# EasyEDA Pro project Chessboards.epro, board Diagonal (continued)
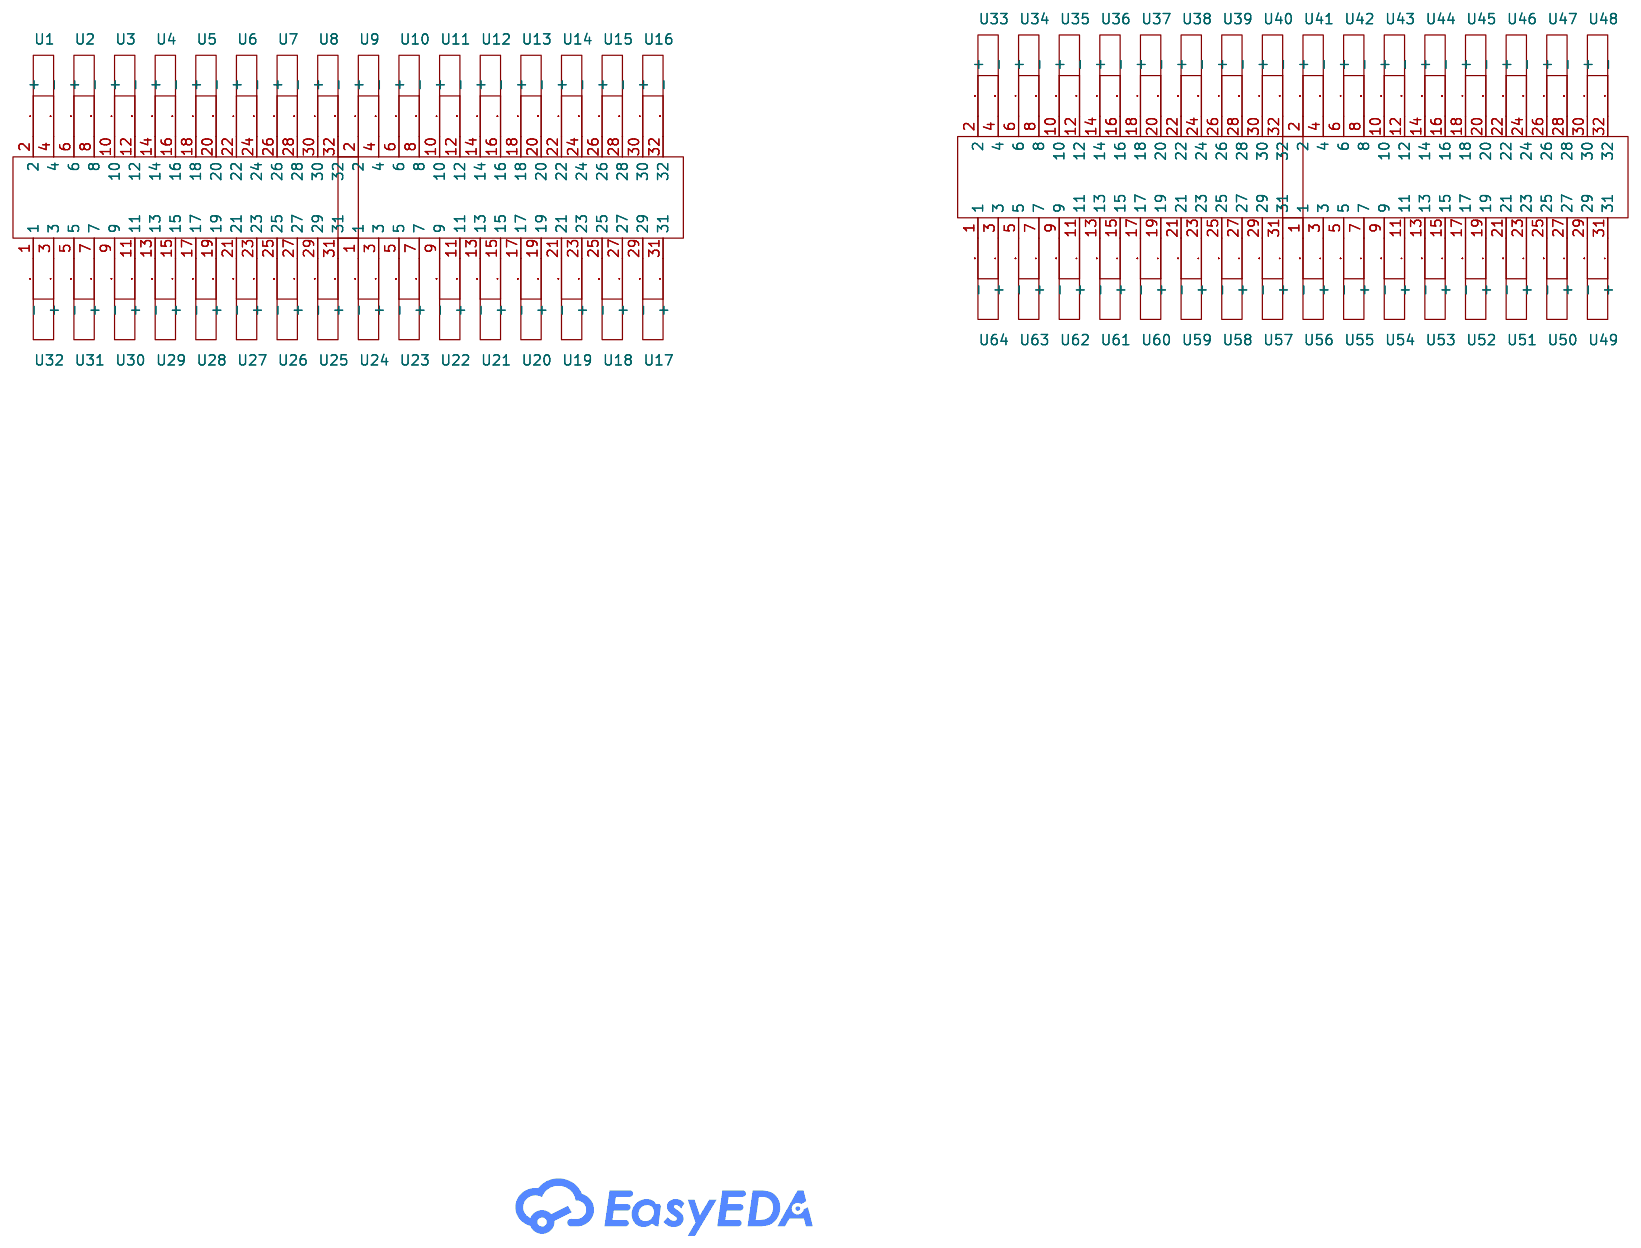
[diagram p0: schematic sheet]
## Routing (per net, layer and track width the routed paths; a pad name or vN(x,y) marks a point on that pad's centre or on a via; arc(x,y) is an arc through that point) (continued)
  Inner4 w0.254: 348.2,56.76 348.2,41.02 353.62,35.6 373.32,35.6 374.13,34.8 374.13,31.6 370,27.47 v2(370,3.71) ; 149.8,54.06 149.8,41.6 155.37,36.03 157.69,36.03 158.7,35.02 158.7,30.76 155.49,27.55 155.49,3.72 ; v2(98.75,476.35) 98.75,447.24 91.86,440.36 91.86,438.14 79.96,426.24 79.96,411.26 89.72,401.5 95.27,401.5 95.45,401.68 90.62,406.51 v1(90.62,407.02) ; 191.24,56.44 191.24,41.29 196.24,36.29 215.94,36.29 217.17,35.07 217.17,29.74 214.87,27.44 214.87,3.69 ; 171.41,53.21 171.41,53.72 169.8,55.33 169.8,60.02 165.89,63.93 160.19,63.93 150.17,53.91 ; 153.02,52.73 161.37,61.08 164.71,61.08 166.95,58.84 166.95,57.26 163.41,53.72 163.41,53.21 ; 35.68,55.58 40.26,60.15 48.37,60.15 49.38,59.14 49.38,55.97 47.13,53.72 U3.10 ; v2(75.47,476.35) 75.47,445.34 70.42,440.29 70.42,436.54 67.53,433.65 47.45,433.65 44.25,430.44 ; 348.9,56.46 354.73,62.29 364.61,62.29 366.87,60.02 366.87,55.33 368.48,53.72 368.48,53.21 ; U5.70 379.61,406.56 376.07,403.02 376.07,399.81 373.18,396.92 360.29,396.92 355.71,401.5 355.71,432.11 ; 209.81,53.19 209.81,53.69 208.85,54.66 208.85,59.85 206.79,61.9 197.2,61.9 191.59,56.29 ; 110.97,57.05 117.63,63.71 128.69,63.71 131.79,60.61 131.79,57.9 135.97,53.72 v1(135.97,53.21) ; 436.69,431.22 436.69,402.38 440.01,399.05 451.13,399.05 452.77,400.69 452.77,406.23 452.45,406.56 452.45,407.06 ; 308.21,53.76 318.02,63.58 323.42,63.58 327.12,59.87 327.12,54.68 328.09,53.72 328.09,53.21 ; v1(288.72,407.02) 288.72,406.51 292.9,402.33 292.9,401.54 292.51,401.15 283.16,401.15 281.09,403.22 281.09,430.29 ; 121.64,431.06 125.68,435.1 145.75,435.1 147.81,437.16 147.81,443.99 149.19,445.37 149.19,476.38 ; 193.37,55.55 193.37,42.18 197.12,38.43 216.83,38.43 219.3,35.95 219.3,30.66 222.52,27.44 222.52,3.69 ; 199.44,431.47 204.11,436.14 224.18,436.14 225.61,437.57 225.61,443.96 224.23,445.34 v2(224.23,476.35) ; 124.97,53.21 124.97,53.72 127.87,56.61 127.87,58.99 127.06,59.79 119.25,59.79 114.88,55.43 ; 462.85,3.71 462.85,27.47 456.89,33.44 456.89,36.42 453.79,39.52 434.08,39.52 430.96,42.64 430.96,55.13 ; 455.69,476.39 455.69,445.38 460.74,440.33 460.74,438.2 460.14,437.61 440.07,437.61 434.56,432.1 ; 32.13,57.05 32.13,40.73 37.97,34.89 57.67,34.89 58.06,34.5 58.06,33.44 52.09,27.47 v2(52.09,3.71) ; 43.52,430.74 43.52,402.78 46.22,400.08 56.46,400.08 57.47,401.09 57.47,404.26 55.22,406.51 U2.120 ; 438.11,430.63 438.11,402.97 440.6,400.48 450.54,400.48 451.35,401.28 451.35,403.66 448.45,406.56 448.45,407.06 ; v2(252.61,476.35) 252.61,447.24 248.48,443.11 248.48,438.59 236.57,426.69 236.57,410.82 246.96,400.44 253.4,400.44 254.21,401.24 254.21,403.62 251.31,406.51 v1(251.31,407.02) ; v2(234.43,476.35) 234.43,445.34 228.46,439.37 228.46,436.39 225.36,433.29 205.29,433.29 202.28,430.29 ; v2(239.87,476.35) 239.87,447.24 244.92,442.19 244.92,440.06 233.01,428.16 233.01,409.35 245.49,396.88 254.87,396.88 257.76,399.77 257.76,402.97 261.31,406.51 U1.70 ; 347.84,56.9 347.84,40.88 353.47,35.25 373.17,35.25 373.77,34.65 373.77,32.52 368.72,27.47 v2(368.72,3.71) ; v2(71.55,3.72) 71.55,27.55 78.31,34.3 78.31,34.56 78.25,34.61 75.93,34.61 69.53,41.01 69.53,54.65 ; 311.41,52.44 319.35,60.37 322.1,60.37 323.79,58.67 323.79,58.42 319.09,53.72 319.09,53.21 ; 140.27,476.38 140.27,445.37 145.32,440.32 145.32,438.19 144.72,437.59 124.65,437.59 119.15,432.09 ; 44.59,430.29 44.59,403.22 46.66,401.15 56.01,401.15 56.4,401.54 56.4,402.33 52.22,406.51 v1(52.22,407.02) ; 213.81,53.19 213.81,53.69 210.27,57.23 210.27,60.44 207.38,63.33 196.61,63.33 190.16,56.88 ; 180.44,407.04 180.44,406.54 178.19,404.29 178.19,400.09 175.71,397.61 166.91,397.61 154.86,409.67 154.86,427.89 166.76,439.79 166.76,444.05 163.55,447.27 163.55,476.37 ; 197.65,432.21 197.65,401.3 202.43,396.52 215.61,396.52 218.71,399.62 218.71,402.33 222.9,406.51 U1.100 ; U1.50 294.72,406.51 295.04,406.19 295.04,400.65 293.4,399.01 282.28,399.01 278.95,402.34 278.95,431.18 ; 352.11,55.13 356.05,59.08 363.28,59.08 363.67,58.69 363.67,57.9 359.48,53.72 v1(359.48,53.21) ; 462.06,476.39 462.06,445.38 462.52,444.92 462.52,437.47 460.88,435.83 440.8,435.83 436.34,431.37 ; 123.05,430.47 123.05,403.1 125.33,400.82 134.98,400.82 135.57,401.41 135.57,403 132.03,406.54 v1(132.03,407.02) 132.03,407.04 ; 320.09,53.21 320.09,53.72 324.28,57.9 324.28,58.69 322.24,60.73 319.2,60.73 311.06,52.58 ; 356.78,431.67 356.78,401.94 360.73,397.99 372.74,397.99 375,400.25 375,404.95 376.61,406.56 U5.76 ; 371.48,53.21 371.48,53.72 367.94,57.26 367.94,60.46 365.05,63.35 354.28,63.35 347.83,56.9 ; 309.62,53.17 309.62,42.49 313.94,38.17 316.26,38.17 318.52,35.91 318.52,29.84 320.82,27.55 320.82,3.72 ; 309.42,476.35 309.42,445.34 306.21,442.13 306.21,436.83 303.73,434.36 283.66,434.36 280.03,430.74 ; 231.5,52.85 240.06,61.41 243.69,61.41 246.15,58.96 246.15,56.59 243.25,53.69 U4.40 243.25,53.19 ; 167.37,476.37 167.37,447.27 167.83,446.81 167.83,439.35 155.93,427.45 155.93,410.11 167.36,398.68 175.27,398.68 177.12,400.53 177.12,406.22 177.44,406.54 177.44,407.04 ; 95.62,407.02 95.62,406.51 97.23,404.9 97.23,400.95 96.01,399.72 88.98,399.72 78.18,410.53 78.18,426.98 90.08,438.88 90.08,444.95 92.38,447.24 v2(92.38,476.35) ; U4.78 285.66,53.72 286.62,54.68 286.62,59.43 285.19,60.86 276.49,60.86 271.5,55.87 ; 173.41,53.21 173.41,53.72 170.51,56.61 170.51,60.32 166.18,64.64 159.89,64.64 149.46,54.21 ; 437.06,431.07 441.1,435.11 461.17,435.11 463.23,437.17 463.23,444.01 464.61,445.38 464.61,476.39 ; 272.92,55.28 277.08,59.44 284.6,59.44 285.2,58.84 285.2,57.26 281.66,53.72 U4.70 ; U6.54 407.92,53.72 406.31,55.33 406.31,60.02 402.4,63.93 396.7,63.93 386.68,53.91 ; 356.07,431.96 356.07,401.64 360.44,397.28 373.03,397.28 375.71,399.96 375.71,403.66 378.61,406.56 U5.72 ; v2(221.69,476.35) 221.69,445.34 224.9,442.13 224.9,437.87 223.88,436.85 203.81,436.85 198.72,431.77 ; v2(71.65,476.35) 71.65,445.34 69.35,443.05 69.35,436.98 67.09,434.72 47.01,434.72 43.18,430.88 ; 449.45,407.06 449.45,406.56 451.71,404.3 451.71,401.13 450.69,400.12 440.46,400.12 437.76,402.82 437.76,430.78 ; 269.72,56.61 275.75,62.64 285.93,62.64 288.4,60.17 288.4,55.97 290.66,53.72 U4.88 ; 434.55,432.1 434.55,401.49 439.13,396.92 452.02,396.92 454.91,399.81 454.91,403.01 458.45,406.56 458.45,407.06 ; 34.26,56.17 39.67,61.57 48.96,61.57 50.81,59.73 50.81,54.04 51.13,53.72 U3.18 ; 113.11,56.17 113.11,41.61 117.69,37.03 137.4,37.03 139.04,35.39 139.04,27.93 138.58,27.47 138.58,3.71 ; U1.88 252.31,406.51 254.56,404.26 254.56,401.09 253.55,400.08 246.81,400.08 236.22,410.68 236.22,426.83 248.12,438.73 248.12,444.03 251.33,447.24 v2(251.33,476.35) ; 198.71,431.77 198.71,401.75 202.87,397.59 215.17,397.59 217.65,400.06 217.65,404.26 219.9,406.51 U1.106 ; U5.52 412.02,406.56 412.99,405.59 412.99,400.84 411.55,399.41 404.23,399.41 393.22,410.43 393.22,427.17 405.12,439.07 405.12,445.91 406.5,447.29 406.5,476.39 ; 95.56,53.21 95.56,53.72 92.02,57.26 92.02,60.46 87.48,65 80.9,65 70.26,54.35 ; 200.86,430.88 204.69,434.72 224.77,434.72 227.03,436.98 227.03,443.05 229.33,445.34 v2(229.33,476.35) ; 358.57,430.93 362.41,434.76 382.48,434.76 384.75,437.03 384.75,443.09 387.04,445.39 387.04,476.4 ; 438.47,430.48 438.47,403.11 440.75,400.83 450.4,400.83 450.99,401.43 450.99,403.01 447.45,406.56 447.45,407.06 ; 306.46,3.71 306.46,27.47 299.57,34.36 299.57,36.57 296.26,39.88 276.56,39.88 273.64,42.79 273.64,54.99 ; 41.75,431.47 46.42,436.14 66.5,436.14 67.93,437.57 67.93,443.96 66.55,445.34 v2(66.55,476.35) ; 358.22,431.08 362.26,435.12 382.34,435.12 384.39,437.18 384.39,444.01 385.77,445.39 385.77,476.4 ; v2(66.11,3.71) 66.11,27.47 61.98,31.6 61.98,36.13 59.29,38.81 39.59,38.81 36.05,42.35 36.05,55.43 ; 356.79,431.67 361.67,436.54 381.75,436.54 382.97,437.76 382.97,443.09 380.67,445.39 380.67,476.4 ; 71.67,53.76 71.67,41.9 76.82,36.75 79.14,36.75 80.57,35.32 80.57,28.92 79.19,27.55 v2(79.19,3.72) ; 268.29,57.2 275.16,64.07 286.52,64.07 289.83,60.76 289.83,58.55 294.66,53.72 v1(294.66,53.21) ; 133.03,407.04 v1(133.03,407.02) 133.03,406.54 135.93,403.64 135.93,401.27 135.12,400.46 125.18,400.46 122.69,402.95 122.69,430.61 ; 118.78,432.24 118.78,401.33 123.56,396.55 136.75,396.55 139.85,399.65 139.85,402.35 144.03,406.54 144.03,407.04 ; 114.53,55.58 119.1,60.15 127.21,60.15 128.23,59.14 128.23,55.97 125.97,53.72 125.97,53.21 ; 348.55,56.61 348.55,41.17 353.76,35.96 373.47,35.96 374.48,34.95 374.48,30.68 371.27,27.47 v2(371.27,3.71) ; 429.53,55.72 434.31,60.51 442.71,60.51 443.94,59.28 443.94,55.33 442.33,53.72 U6.76 ; 272.57,55.43 272.57,42.35 276.11,38.81 295.82,38.81 298.5,36.13 298.5,31.6 302.63,27.47 302.63,3.71 ; 205.81,53.19 205.81,53.69 207.42,55.3 207.42,59.26 206.2,60.48 197.79,60.48 193.01,55.7 ; 110.97,57.05 110.97,40.73 116.81,34.89 136.52,34.89 136.9,34.5 136.9,33.44 130.94,27.47 130.94,3.71 ; 456.45,407.06 456.45,406.56 454.2,404.3 454.2,400.1 451.72,397.63 439.42,397.63 435.27,401.79 435.27,431.81 ; U2.116 57.22,406.51 58.18,405.55 58.18,400.8 56.75,399.37 45.93,399.37 42.81,402.48 42.81,431.03 ; 141.13,3.71 141.13,27.47 139.75,28.85 139.75,35.68 137.69,37.74 117.99,37.74 113.82,41.91 113.82,55.87 ; 35.69,55.58 35.69,42.2 39.44,38.45 59.15,38.45 61.62,35.98 61.62,30.68 64.83,27.47 v2(64.83,3.71) ; 155.56,476.38 155.56,445.37 149.59,439.4 149.59,436.42 146.49,433.32 126.42,433.32 123.42,430.32 ; 36.76,55.13 36.76,42.64 39.88,39.52 59.59,39.52 62.69,36.42 62.69,33.44 68.65,27.47 v2(68.65,3.71) ; 42.47,431.18 46.72,435.43 66.79,435.43 68.64,437.28 68.64,444.88 69.1,445.34 v2(69.1,476.35) ; U3.22 53.13,53.72 51.52,55.33 51.52,60.02 49.25,62.29 39.37,62.29 33.55,56.46 ; 153.01,476.38 153.01,445.37 148.88,441.24 148.88,436.71 146.2,434.03 126.12,434.03 122.71,430.61 ; 167.41,53.21 167.41,53.72 168.37,54.68 168.37,59.43 165.3,62.51 160.78,62.51 151.59,53.32 ; v1(53.22,407.02) 53.22,406.51 56.76,402.97 56.76,401.39 56.16,400.79 46.51,400.79 44.23,403.07 44.23,430.44 ; 120.93,431.35 125.39,435.81 145.46,435.81 147.1,437.45 147.1,444.91 146.64,445.37 146.64,476.38 ; 121.99,430.91 125.83,434.74 145.9,434.74 148.17,437.01 148.17,443.07 150.46,445.37 150.46,476.38 ; 308.15,476.35 308.15,445.34 305.85,443.05 305.85,436.98 303.59,434.72 283.51,434.72 279.68,430.88 ; 452.66,3.71 452.66,27.47 454.04,28.85 454.04,35.24 452.61,36.67 432.9,36.67 428.11,41.46 428.11,56.31 ; 426.68,56.9 433.13,63.35 443.89,63.35 446.78,60.46 446.78,57.26 450.33,53.72 v1(450.33,53.21) ; v2(390.73,3.72) 390.73,27.55 394.86,31.68 394.86,34.87 394.05,35.68 391.73,35.68 385.96,41.45 385.96,54.21 ; 459.45,407.06 459.45,406.56 455.26,402.37 455.26,399.66 452.17,396.56 438.98,396.56 434.2,401.34 434.2,432.25 ; 158.04,3.72 158.04,27.55 159.41,28.92 159.41,35.32 157.98,36.75 155.66,36.75 150.51,41.9 150.51,53.76 ; U6.74 441.33,53.72 443.58,55.97 443.58,59.14 442.57,60.15 434.45,60.15 429.88,55.58 ; 41.4,431.62 46.27,436.5 66.35,436.5 67.57,437.72 67.57,443.05 65.28,445.34 v2(65.28,476.35) ; 464.13,3.71 464.13,27.47 457.24,34.36 457.24,36.57 453.93,39.88 434.23,39.88 431.31,42.79 431.31,54.99 ; 278.6,431.32 278.6,402.19 282.13,398.66 293.55,398.66 295.39,400.5 295.39,406.19 295.72,406.51 U1.48 ; 271.86,55.72 271.86,42.06 275.82,38.1 295.53,38.1 297.79,35.83 297.79,29.77 300.09,27.47 300.09,3.71 ; U1.40 299.72,406.51 296.82,403.62 296.82,399.91 294.13,397.23 281.54,397.23 277.17,401.6 277.17,431.91 ; 306.06,54.65 306.06,41.01 312.46,34.61 314.78,34.61 314.83,34.56 314.83,34.3 308.08,27.55 308.08,3.72 ; v2(86.01,476.35) 86.01,447.24 88.3,444.95 88.3,439.62 76.4,427.72 76.4,409.79 88.25,397.94 96.75,397.94 99.01,400.21 99.01,404.9 100.62,406.51 100.62,407.02 ; 230.79,53.15 239.77,62.13 243.99,62.13 246.86,59.26 246.86,55.3 245.25,53.69 U4.44 245.25,53.19 ; 389.17,52.88 397.73,61.44 401.36,61.44 403.82,58.99 403.82,56.61 400.92,53.72 U6.40 ; 72.04,53.62 81.64,63.22 86.75,63.22 90.24,59.73 90.24,54.04 90.56,53.72 90.56,53.21 ; 151.67,3.72 151.67,27.55 157.63,33.51 157.63,34.58 157.25,34.97 154.93,34.97 148.73,41.16 148.73,54.5 ; 305.18,3.71 305.18,27.47 299.21,33.44 299.21,36.42 296.12,39.52 276.41,39.52 273.28,42.64 273.28,55.13 ; 91.56,53.21 91.56,53.72 90.6,54.68 90.6,59.87 86.9,63.58 81.49,63.58 71.68,53.76 ; 323.36,3.72 323.36,27.55 319.23,31.68 319.23,36.2 316.55,38.88 314.23,38.88 310.33,42.78 310.33,52.88 ; 281.45,430.14 281.45,403.37 283.31,401.5 292.37,401.5 292.55,401.68 287.72,406.51 v1(287.72,407.02) ; 143.68,3.71 143.68,27.47 140.46,30.68 140.46,35.98 137.99,38.45 118.28,38.45 114.53,42.2 114.53,55.58 ; v2(74.19,476.35) 74.19,445.34 70.06,441.21 70.06,436.69 67.38,434 47.31,434 43.89,430.59 ; 151.24,53.47 160.63,62.86 165.44,62.86 168.73,59.58 168.73,54.04 168.41,53.72 168.41,53.21 ; 429.18,55.87 429.18,41.91 433.34,37.74 453.05,37.74 455.11,35.68 455.11,28.85 456.48,27.47 456.48,3.71 ; 190.17,56.88 190.17,40.85 195.8,35.22 215.5,35.22 216.1,34.62 216.1,32.49 211.05,27.44 211.05,3.69 ; v2(220.41,476.35) 220.41,445.34 224.54,441.21 224.54,438.01 223.74,437.21 203.66,437.21 198.37,431.91 ; 192.3,55.99 197.5,61.19 206.49,61.19 208.13,59.55 208.13,54.01 207.81,53.69 207.81,53.19 ; v1(452.33,53.21) 452.33,53.72 447.5,58.55 447.5,60.76 444.19,64.07 432.83,64.07 425.97,57.2 ; 367.48,53.21 367.48,53.72 366.52,54.68 366.52,59.87 364.46,61.93 354.87,61.93 349.26,56.31 ; 355.01,432.4 360.93,438.32 381.01,438.32 381.19,438.5 374.3,445.39 374.3,476.4 ; U6.86 447.33,53.72 445.72,55.33 445.72,60.02 443.45,62.29 433.57,62.29 427.75,56.46 ; 336.12,407.02 336.12,406.51 335.16,405.55 335.16,400.36 333.1,398.3 324.89,398.3 313.25,409.94 313.25,427.57 325.16,439.47 325.16,445.86 323.78,447.24 323.78,476.35 ; U4.66 279.66,53.72 284.49,58.55 284.31,58.73 277.37,58.73 273.63,54.99 ; 296.68,476.35 296.68,445.34 302.65,439.37 302.65,438.31 302.26,437.92 282.18,437.92 276.47,432.21 ; 74.87,52.44 74.87,43.22 78.15,39.95 80.47,39.95 83.77,36.64 83.77,34.43 90.66,27.55 v2(90.66,3.72) ; 166.95,3.72 166.95,27.55 161.91,32.59 161.91,36.35 159.01,39.24 156.69,39.24 153,42.93 153,52.73 ; 437.41,430.92 441.25,434.76 461.32,434.76 463.59,437.02 463.59,443.09 465.88,445.38 465.88,476.39 ; 389.59,476.4 389.59,445.39 385.46,441.26 385.46,436.73 382.78,434.05 362.7,434.05 359.29,430.63 ; v2(75.37,3.72) 75.37,27.55 79.5,31.68 79.5,34.87 78.7,35.68 76.38,35.68 70.6,41.45 70.6,54.21 ; 113.46,56.02 113.46,41.76 117.84,37.38 137.55,37.38 139.4,35.54 139.4,27.93 139.85,27.47 139.85,3.71 ; U1.118 213.9,406.51 215.51,404.9 215.51,400.95 214.29,399.72 203.76,399.72 200.85,402.63 200.85,430.88 ; v2(402.19,3.72) 402.19,27.55 398.06,31.68 398.06,36.2 395.38,38.88 393.06,38.88 389.16,42.78 389.16,52.88 ; U5.64 406.02,406.56 410.85,401.73 410.67,401.55 405.12,401.55 395.36,411.31 395.36,426.29 407.26,438.19 407.26,440.4 414.14,447.29 414.14,476.39 ; 437.05,431.07 437.05,402.52 440.16,399.41 450.99,399.41 452.42,400.84 452.42,405.59 451.45,406.56 451.45,407.06 ; 357.51,431.37 361.97,435.83 382.04,435.83 383.68,437.47 383.68,444.93 383.22,445.39 383.22,476.4 ; 271.5,55.87 271.5,41.91 275.67,37.74 295.38,37.74 297.43,35.68 297.43,28.85 298.81,27.47 298.81,3.71 ; 453.14,476.39 453.14,445.38 460.03,438.5 459.85,438.32 439.77,438.32 433.85,432.4 ; 387.74,53.47 387.74,42.19 392.47,37.46 394.79,37.46 396.64,35.61 396.64,28 397.1,27.55 v2(397.1,3.72) ; 145.37,476.38 145.37,445.37 146.74,443.99 146.74,437.6 145.31,436.17 125.24,436.17 120.57,431.5 ; 269.36,56.76 275.6,63 286.08,63 288.76,60.32 288.76,56.61 291.66,53.72 v1(291.66,53.21) ; 296.26,3.71 296.26,27.47 296.72,27.93 296.72,35.39 295.08,37.03 275.38,37.03 270.79,41.61 270.79,56.17 ; v1(210.9,407.02) 210.9,406.51 214.44,402.97 214.44,401.39 213.84,400.79 204.2,400.79 201.92,403.07 201.92,430.44 ; 119.86,431.79 124.94,436.88 145.02,436.88 146.03,437.89 146.03,442.15 142.82,445.37 142.82,476.38 ; 231.13,53 231.13,42.61 235.24,38.5 237.56,38.5 240.03,36.03 240.03,30.73 243.25,27.52 243.25,3.69 ; 119.13,432.09 119.13,401.48 123.71,396.9 136.6,396.9 139.49,399.79 139.49,403 143.03,406.54 143.03,407.04 ; 270.07,56.46 275.9,62.29 285.78,62.29 288.05,60.02 288.05,55.33 289.66,53.72 U4.86 ; 176.44,407.04 176.44,406.54 176.76,406.22 176.76,400.68 175.12,399.04 167.5,399.04 156.28,410.26 156.28,427.3 168.19,439.2 168.19,446.81 168.64,447.27 168.64,476.37 ; 301.36,3.71 301.36,27.47 298.15,30.68 298.15,35.98 295.67,38.45 275.97,38.45 272.22,42.2 272.22,55.58 ; U2.106 62.22,406.51 59.96,404.26 59.96,400.06 57.49,397.59 45.19,397.59 41.03,401.75 41.03,431.77 ; 270.44,56.31 270.44,41.46 275.23,36.67 294.94,36.67 296.37,35.24 296.37,28.85 294.99,27.47 294.99,3.71 ; 244.25,53.19 U4.42 244.25,53.69 246.5,55.94 246.5,59.11 243.84,61.77 239.91,61.77 231.14,53 ; 388.46,53.17 397.44,62.15 401.66,62.15 404.53,59.28 404.53,55.33 402.92,53.72 U6.44 ; 230.78,53.15 230.78,42.46 235.09,38.14 237.41,38.14 239.68,35.88 239.68,29.81 241.97,27.52 241.97,3.69 ; 385.6,54.35 385.6,41.31 391.58,35.32 393.9,35.32 394.5,34.73 394.5,32.59 389.45,27.55 v2(389.45,3.72) ; 74.52,52.58 74.52,43.08 78,39.59 80.32,39.59 83.42,36.5 83.42,33.51 89.38,27.55 v2(89.38,3.72) ; 148.77,3.71 148.77,27.47 141.89,34.36 141.89,36.57 138.58,39.88 118.87,39.88 115.96,42.79 115.96,54.99 ; 411.59,476.39 411.59,447.29 406.54,442.24 406.54,438.49 394.64,426.58 394.64,411.02 404.82,400.84 410.97,400.84 411.56,401.43 411.56,403.02 408.02,406.56 U5.60 ; 292.44,3.71 292.44,27.47 295.65,30.68 295.65,34.95 294.64,35.96 274.94,35.96 269.72,41.17 269.72,56.61 ; 357.85,431.22 357.85,402.38 361.17,399.06 372.29,399.06 373.93,400.7 373.93,406.24 373.61,406.56 U5.82 ; 455.45,407.06 455.45,406.56 453.84,404.94 453.84,400.25 451.58,397.99 439.57,397.99 435.62,401.93 435.62,431.66 ; 162.41,53.21 162.41,53.72 166.59,57.9 166.59,58.69 164.56,60.73 161.52,60.73 153.37,52.58 ; 181.44,407.04 181.44,406.54 178.54,403.64 178.54,399.94 175.86,397.26 166.77,397.26 154.5,409.52 154.5,428.04 166.41,439.94 166.41,443.14 162.27,447.27 162.27,476.37 ; U6.82 445.33,53.72 445,54.04 445,59.73 443.16,61.57 433.87,61.57 428.46,56.17 ; 163.13,3.72 163.13,27.55 160.84,29.84 160.84,35.91 158.57,38.17 156.25,38.17 151.94,42.49 151.94,53.17 ; 140.03,407.04 140.03,406.54 138.42,404.93 138.42,400.24 136.16,397.97 124.15,397.97 120.2,401.92 120.2,431.65 ; v2(64,476.35) 64,445.34 67.22,442.13 67.22,437.87 66.2,436.85 46.13,436.85 41.04,431.77 ; v1(358.48,53.21) 358.48,53.72 363.31,58.55 363.13,58.73 356.2,58.73 352.46,54.99 ; 232.56,52.41 232.56,43.2 235.83,39.92 238.15,39.92 241.46,36.62 241.46,34.4 248.34,27.52 248.34,3.69 ; 209.78,3.69 209.78,27.44 215.74,33.41 215.74,34.48 215.35,34.87 195.65,34.87 189.81,40.7 189.81,57.03 ; 227.58,54.48 238.44,65.33 245.32,65.33 250.06,60.58 250.06,57.88 254.25,53.69 v1(254.25,53.21) 254.25,53.19 ; v2(253.88,476.35) 253.88,447.24 248.83,442.19 248.83,438.44 236.93,426.54 236.93,410.97 247.11,400.79 253.25,400.79 253.85,401.39 253.85,402.97 250.31,406.51 v1(250.31,407.02) ; v2(77.92,3.72) 77.92,27.55 80.21,29.84 80.21,35.17 78.99,36.39 76.67,36.39 71.31,41.75 71.31,53.91 ; 229.35,53.74 229.35,41.87 234.5,36.72 236.82,36.72 238.25,35.29 238.25,28.9 236.88,27.52 236.88,3.69 ; 358.56,430.93 358.56,402.68 361.47,399.77 372,399.77 373.22,400.99 373.22,404.95 371.61,406.56 U5.86 ; v2(59.74,3.71) 59.74,27.47 60.2,27.93 60.2,35.39 58.56,37.03 38.85,37.03 34.27,41.61 34.27,56.17 ; v2(69.93,3.71) 69.93,27.47 63.04,34.36 63.04,36.57 59.74,39.88 40.03,39.88 37.11,42.79 37.11,54.99 ; 39.97,432.21 45.68,437.92 65.76,437.92 66.15,438.31 66.15,439.37 60.18,445.34 v2(60.18,476.35) ; 279.31,431.03 279.31,402.48 282.42,399.37 293.25,399.37 294.68,400.8 294.68,405.55 293.72,406.51 U1.52 ; 362.48,53.21 362.48,53.72 364.74,55.97 364.74,59.14 363.72,60.15 355.61,60.15 351.04,55.58 ; 197.3,432.36 203.22,438.28 223.29,438.28 223.47,438.46 216.59,445.34 v2(216.59,476.35) ; 227.94,54.33 238.59,64.97 245.17,64.97 249.71,60.44 249.71,57.23 253.25,53.69 v1(253.25,53.21) 253.25,53.19 ; 324.09,53.21 324.09,53.72 325.7,55.33 325.7,59.28 322.83,62.15 318.61,62.15 309.63,53.17 ; v2(80.91,476.35) 80.91,447.24 86.88,441.27 86.88,440.21 74.98,428.31 74.98,409.2 87.66,396.52 97.34,396.52 100.44,399.62 100.44,402.33 104.62,406.51 104.62,407.02 ; 171.44,407.04 171.44,406.54 174.98,403 174.98,401.41 174.39,400.82 168.24,400.82 158.06,411 158.06,426.56 169.97,438.47 169.97,442.22 175.01,447.27 175.01,476.37 ; 322.09,53.21 322.09,53.72 324.99,56.61 324.99,58.99 322.54,61.44 318.9,61.44 310.34,52.88 ; v2(84.73,476.35) 84.73,447.24 87.95,444.03 87.95,439.77 76.04,427.87 76.04,409.64 88.1,397.59 96.9,397.59 99.37,400.06 99.37,404.26 101.62,406.51 101.62,407.02 ; 460.45,407.06 460.45,406.56 455.62,401.73 455.62,399.51 452.31,396.21 438.83,396.21 433.84,401.2 433.84,432.4 ; 141.54,476.38 141.54,445.37 145.68,441.24 145.68,438.04 144.87,437.24 124.8,437.24 119.5,431.94 ; 304.32,476.35 304.32,445.34 304.78,444.88 304.78,437.42 303.14,435.78 283.07,435.78 278.61,431.32 ; 35.33,55.72 40.11,60.51 48.52,60.51 49.74,59.28 49.74,55.33 48.13,53.72 U3.12 ; 437.77,430.78 441.39,434.4 461.47,434.4 463.94,436.88 463.94,442.17 467.15,445.38 467.15,476.39 ; 355.73,432.11 361.23,437.61 381.3,437.61 381.9,438.21 381.9,440.34 376.85,445.39 376.85,476.4 ; 115.6,55.13 115.6,42.64 118.73,39.52 138.43,39.52 141.53,36.42 141.53,33.44 147.5,27.47 147.5,3.71 ; 191.59,56.29 191.59,41.44 196.39,36.65 216.09,36.65 217.52,35.21 217.52,28.82 216.15,27.44 216.15,3.69 ; 355.36,432.26 355.36,401.35 360.14,396.57 373.33,396.57 376.43,399.66 376.43,402.37 380.61,406.56 U5.68 ; 359.99,430.34 359.99,403.27 362.06,401.19 371.41,401.19 371.8,401.58 371.8,402.37 367.61,406.56 U5.94 ; 111.32,56.9 117.77,63.35 128.54,63.35 131.43,60.46 131.43,57.26 134.97,53.72 v1(134.97,53.21) ; 388.32,476.4 388.32,445.39 385.1,442.17 385.1,436.88 382.63,434.41 362.56,434.41 358.93,430.78 ; 191.95,56.14 191.95,41.59 196.53,37 216.24,37 217.88,35.36 217.88,27.9 217.42,27.44 217.42,3.69 ; 131.03,407.04 v1(131.03,407.02) 131.03,406.54 135.22,402.35 135.22,401.56 134.83,401.17 125.48,401.17 123.41,403.25 123.41,430.32 ; 297.54,3.71 297.54,27.47 297.08,27.93 297.08,35.54 295.23,37.38 275.52,37.38 271.15,41.76 271.15,56.02 ; U1.38 300.72,406.51 297.17,402.97 297.17,399.77 294.28,396.88 281.39,396.88 276.82,401.45 276.82,432.06 ; 427.39,56.61 433.42,62.64 443.6,62.64 446.07,60.17 446.07,55.97 448.33,53.72 U6.88 ; 99.62,407.02 99.62,406.51 98.66,405.55 98.66,400.36 96.6,398.3 88.39,398.3 76.76,409.94 76.76,427.57 88.66,439.47 88.66,445.86 87.28,447.24 v2(87.28,476.35) ; 358.92,430.78 358.92,402.82 361.62,400.13 371.85,400.13 372.87,401.14 372.87,404.31 370.61,406.56 U5.88 ; 268.65,57.05 275.31,63.71 286.37,63.71 289.47,60.61 289.47,57.9 293.66,53.72 v1(293.66,53.21) ; 347.48,57.05 354.14,63.71 365.2,63.71 368.3,60.61 368.3,57.9 372.48,53.72 372.48,53.21 ; 94.62,407.02 94.62,406.51 96.88,404.26 96.88,401.09 95.86,400.08 89.13,400.08 78.54,410.68 78.54,426.83 90.44,438.73 90.44,444.03 93.65,447.24 v2(93.65,476.35) ; v1(208.9,407.02) 208.9,406.51 213.73,401.68 213.55,401.5 204.49,401.5 202.63,403.37 202.63,430.14 ; U1.80 256.31,406.51 255.99,406.19 255.99,400.5 254.14,398.66 246.22,398.66 234.79,410.08 234.79,427.42 246.7,439.32 246.7,446.78 246.24,447.24 v2(246.24,476.35) ; U5.44 416.02,406.56 414.41,404.95 414.41,400.25 412.14,397.99 403.64,397.99 391.8,409.84 391.8,427.76 403.7,439.66 403.7,444.99 401.4,447.29 401.4,476.39 ; v2(83.46,476.35) 83.46,447.24 87.59,443.11 87.59,439.91 75.69,428.01 75.69,409.5 87.95,397.23 97.04,397.23 99.73,399.91 99.73,403.62 102.62,406.51 102.62,407.02 ; 434.91,431.96 434.91,401.64 439.28,397.27 451.87,397.27 454.55,399.96 454.55,403.66 457.45,406.56 457.45,407.06 ; 42.11,431.32 46.57,435.78 66.64,435.78 68.28,437.42 68.28,444.88 67.82,445.34 v2(67.82,476.35) ; 42.45,431.18 42.45,402.34 45.78,399.01 56.9,399.01 58.54,400.65 58.54,406.19 58.22,406.51 U2.114 ; 445.02,3.71 445.02,27.47 451.77,34.23 451.77,34.48 451.72,34.54 432.02,34.54 425.97,40.58 425.97,57.2 ; 228.65,54.03 238.88,64.26 244.87,64.26 248.99,60.14 248.99,55.94 251.25,53.69 U4.56 251.25,53.19 ; 429.89,55.58 429.89,42.2 433.64,38.45 453.34,38.45 455.82,35.98 455.82,30.68 459.03,27.47 459.03,3.71 ; v2(67.38,3.71) 67.38,27.47 62.33,32.52 62.33,36.27 59.44,39.16 39.74,39.16 36.4,42.5 36.4,55.28 ; 460.78,476.39 460.78,445.38 462.16,444.01 462.16,437.61 460.73,436.18 440.66,436.18 435.99,431.51 ; 434.92,431.96 440.22,437.25 460.29,437.25 461.09,438.06 461.09,441.25 456.96,445.38 456.96,476.39 ; v2(80.47,3.72) 80.47,27.55 80.93,28 80.93,35.46 79.29,37.1 76.97,37.1 72.03,42.04 72.03,53.62 ; 269.01,56.9 275.46,63.35 286.22,63.35 289.11,60.46 289.11,57.26 292.66,53.72 v1(292.66,53.21) ; 210.81,53.19 210.81,53.69 209.2,55.3 209.2,60 206.94,62.26 197.06,62.26 191.23,56.44 ; 129.97,53.21 129.97,53.72 129.65,54.04 129.65,59.73 127.8,61.57 118.51,61.57 113.1,56.17 ; 299.23,476.35 299.23,445.34 303.36,441.21 303.36,438.01 302.55,437.21 282.48,437.21 277.19,431.91 ; 436.7,431.22 440.95,435.47 461.03,435.47 462.87,437.32 462.87,444.92 463.33,445.38 463.33,476.39 ; 44.96,430.14 47.75,432.94 67.82,432.94 71.13,436.24 71.13,438.46 78.02,445.34 v2(78.02,476.35) ; v1(133.97,53.21) 133.97,53.72 131.07,56.61 131.07,60.32 128.39,63 117.92,63 111.68,56.76 ; 276.11,432.36 276.11,401.16 281.1,396.16 294.58,396.16 297.88,399.47 297.88,401.68 302.72,406.51 U1.34 ; 40.69,431.91 45.98,437.21 66.05,437.21 66.86,438.01 66.86,441.21 62.73,445.34 v2(62.73,476.35) ; v2(255.16,476.35) 255.16,447.24 249.19,441.27 249.19,438.29 237.29,426.39 237.29,411.12 247.26,401.15 253.11,401.15 253.49,401.54 253.49,402.33 249.31,406.51 v1(249.31,407.02) ; v1(328.12,407.02) 328.12,406.51 332.31,402.33 332.31,401.54 331.92,401.15 326.07,401.15 316.1,411.12 316.1,426.39 328,438.29 328,441.27 333.97,447.24 333.97,476.35 ; 33.2,56.61 33.2,41.17 38.41,35.96 58.11,35.96 59.13,34.95 59.13,30.68 55.91,27.47 v2(55.91,3.71) ; 437.4,430.92 437.4,402.67 440.31,399.77 450.84,399.77 452.06,400.99 452.06,404.94 450.45,406.56 450.45,407.06 ; 201.93,430.44 205.14,433.65 225.21,433.65 228.1,436.54 228.1,440.29 233.15,445.34 v2(233.15,476.35) ; 269.01,56.9 269.01,40.88 274.64,35.25 294.35,35.25 294.94,34.65 294.94,32.52 289.89,27.47 289.89,3.71 ; U1.120 212.9,406.51 215.15,404.26 215.15,401.09 214.14,400.08 203.9,400.08 201.21,402.78 201.21,430.74 ; 203.81,53.19 v1(203.81,53.21) 203.81,53.69 206.71,56.59 206.71,58.96 205.9,59.77 198.09,59.77 193.72,55.4 ; 112.04,56.61 112.04,41.17 117.25,35.96 136.96,35.96 137.97,34.95 137.97,30.68 134.76,27.47 134.76,3.71 ; 229.36,53.74 239.18,63.55 244.58,63.55 248.28,59.85 248.28,54.66 249.25,53.69 U4.52 249.25,53.19 ; U3.16 50.13,53.72 50.45,54.04 50.45,59.58 48.81,61.22 39.81,61.22 34.62,56.02 ; 152.29,53.03 152.29,42.63 156.4,38.53 158.72,38.53 161.19,36.05 161.19,30.76 164.41,27.55 164.41,3.72 ; 137.31,3.71 137.31,27.47 138.68,28.85 138.68,35.24 137.25,36.67 117.55,36.67 112.75,41.46 112.75,56.31 ; 33.19,56.61 39.22,62.64 49.4,62.64 51.87,60.17 51.87,55.97 54.13,53.72 U3.24 ; 229.01,53.89 239.03,63.91 244.73,63.91 248.64,60 248.64,55.3 250.25,53.69 U4.54 250.25,53.19 ; 190.88,56.58 190.88,41.14 196.09,35.93 215.8,35.93 216.81,34.92 216.81,30.66 213.6,27.44 213.6,3.69 ; 208.5,3.69 208.5,27.44 215.26,34.2 215.26,34.46 215.21,34.51 195.5,34.51 189.46,40.55 189.46,57.17 ; 388.09,53.32 388.09,42.34 392.62,37.81 394.94,37.81 396.99,35.76 396.99,28.92 398.37,27.55 v2(398.37,3.72) ; 40.67,431.91 40.67,401.6 45.04,397.23 57.64,397.23 60.32,399.91 60.32,403.62 63.22,406.51 U2.104 ; U5.96 366.61,406.56 371.44,401.73 371.26,401.55 362.21,401.55 360.34,403.41 360.34,430.19 ; 190.52,56.73 190.52,41 195.94,35.58 215.65,35.58 216.46,34.77 216.46,31.58 212.32,27.44 212.32,3.69 ; 384.49,476.4 384.49,445.39 384.04,444.93 384.04,437.32 382.19,435.47 362.11,435.47 357.86,431.22 ; 385.24,54.5 385.24,41.16 391.44,34.97 393.76,34.97 394.14,34.58 394.14,33.51 388.18,27.55 v2(388.18,3.72) ; U1.86 253.31,406.51 254.92,404.9 254.92,400.95 253.69,399.72 246.67,399.72 235.86,410.53 235.86,426.98 247.76,438.88 247.76,444.95 250.06,447.24 v2(250.06,476.35) ; 122.34,430.76 122.34,402.8 125.04,400.11 135.27,400.11 136.29,401.12 136.29,404.29 134.03,406.54 134.03,407.04 ; v2(226.78,476.35) 226.78,445.34 226.32,444.88 226.32,437.28 224.47,435.43 204.4,435.43 200.15,431.18 ; 153.36,52.58 153.36,43.08 156.84,39.59 159.16,39.59 162.26,36.5 162.26,33.51 168.23,27.55 168.23,3.72 ; 311.9,3.72 311.9,27.55 316.03,31.68 316.03,34.87 315.22,35.68 312.9,35.68 307.13,41.45 307.13,54.21 ; U1.44 297.72,406.51 296.11,404.9 296.11,400.21 293.84,397.94 281.83,397.94 277.89,401.89 277.89,431.62 ; 36.4,55.28 40.55,59.44 48.07,59.44 48.67,58.84 48.67,57.26 45.13,53.72 v1(45.13,53.21) ; 313.24,476.35 313.24,445.34 307.27,439.37 307.27,436.39 304.18,433.29 284.1,433.29 281.1,430.29 ; 410.32,476.39 410.32,447.29 406.19,443.16 406.19,438.63 394.29,426.73 394.29,410.87 404.67,400.48 411.11,400.48 411.92,401.29 411.92,403.66 409.02,406.56 U5.58 ; 115.59,55.13 119.54,59.08 126.77,59.08 127.16,58.69 127.16,57.9 122.97,53.72 122.97,53.21 ; 347.13,57.2 347.13,40.58 353.17,34.54 372.88,34.54 372.93,34.48 372.93,34.23 366.17,27.47 v2(366.17,3.71) ; 193.73,55.4 193.73,42.32 197.27,38.78 216.98,38.78 219.66,36.1 219.66,31.58 223.79,27.44 223.79,3.69 ; 215.81,53.19 215.81,53.69 210.98,58.52 210.98,60.73 207.67,64.04 196.32,64.04 189.45,57.17 ; 232.2,52.56 232.2,43.05 235.68,39.57 238,39.57 241.1,36.47 241.1,33.49 247.07,27.52 247.07,3.69 ; 165.68,3.72 165.68,27.55 161.55,31.68 161.55,36.2 158.87,38.88 156.55,38.88 152.65,42.78 152.65,52.88 ; 183.44,407.04 183.44,406.54 179.25,402.35 179.25,399.65 176.16,396.55 166.47,396.55 153.79,409.23 153.79,428.33 165.69,440.24 165.69,441.3 159.73,447.27 159.73,476.37 ; 308.2,53.76 308.2,41.9 313.35,36.75 315.67,36.75 317.1,35.32 317.1,28.92 315.72,27.55 315.72,3.72 ; 310.69,52.73 310.69,42.93 314.38,39.24 316.7,39.24 319.59,36.35 319.59,32.59 324.64,27.55 324.64,3.72 ; 170.44,407.04 170.44,406.54 174.63,402.35 174.63,401.56 174.24,401.17 168.39,401.17 158.42,411.14 158.42,426.42 170.32,438.32 170.32,441.3 176.29,447.27 176.29,476.37 ; U5.80 374.61,406.56 374.29,406.24 374.29,400.55 372.44,398.7 361.03,398.7 357.49,402.23 357.49,431.37 ; 226.34,3.69 226.34,27.44 220.37,33.41 220.37,36.39 217.27,39.49 197.57,39.49 194.44,42.62 194.44,55.11 ; v2(242.42,476.35) 242.42,447.24 245.63,444.03 245.63,439.77 233.73,427.87 233.73,409.64 245.78,397.59 254.58,397.59 257.05,400.06 257.05,404.26 259.31,406.51 U1.74 ; 225.06,3.69 225.06,27.44 220.01,32.49 220.01,36.25 217.12,39.14 197.42,39.14 194.08,42.47 194.08,55.26 ; 239.42,3.69 239.42,27.52 238.96,27.98 238.96,35.58 237.12,37.43 234.8,37.43 230.06,42.17 230.06,53.44 ; v1(289.72,407.02) 289.72,406.51 293.26,402.97 293.26,401.39 292.66,400.79 283.01,400.79 280.73,403.07 280.73,430.44 ; 229.72,53.59 239.32,63.19 244.43,63.19 247.93,59.7 247.93,54.01 248.25,53.69 U4.50 248.25,53.19 ; 307.48,54.06 307.48,41.6 313.05,36.03 315.37,36.03 316.38,35.02 316.38,30.76 313.17,27.55 313.17,3.72 ; v2(394.55,3.72) 394.55,27.55 395.92,28.92 395.92,35.32 394.49,36.75 392.17,36.75 387.02,41.9 387.02,53.76 ; 311.4,52.44 311.4,43.22 314.67,39.95 316.99,39.95 320.3,36.64 320.3,34.43 327.19,27.55 327.19,3.72 ; 229.23,3.69 229.23,27.52 235.99,34.28 235.99,34.53 235.94,34.58 233.62,34.58 227.22,40.99 227.22,54.62 ; 395.03,476.39 395.03,447.29 401.79,440.53 401.79,440.28 390.02,428.5 390.02,409.1 402.9,396.21 412.88,396.21 416.19,399.52 416.19,401.73 421.02,406.56 U5.34 ; U1.66 263.31,406.51 258.48,401.68 258.48,399.47 255.17,396.16 245.19,396.16 232.3,409.05 232.3,428.45 244.08,440.23 244.08,440.48 237.32,447.24 v2(237.32,476.35) ; 351.75,55.28 355.91,59.44 363.43,59.44 364.02,58.84 364.02,57.26 360.48,53.72 v1(360.48,53.21) ; 43.17,430.88 43.17,402.63 46.07,399.72 56.6,399.72 57.83,400.95 57.83,404.9 56.22,406.51 U2.118 ; 199.08,431.62 203.96,436.5 224.03,436.5 225.25,437.72 225.25,443.05 222.96,445.34 v2(222.96,476.35) ; 273.28,55.13 277.23,59.08 284.45,59.08 284.84,58.69 284.84,57.9 280.66,53.72 U4.68 ; 311.04,52.58 311.04,43.08 314.53,39.59 316.85,39.59 319.94,36.5 319.94,33.51 325.91,27.55 325.91,3.72 ; 405.22,476.39 405.22,447.29 404.76,446.83 404.76,439.22 392.86,427.32 392.86,410.28 404.08,399.06 411.7,399.06 413.34,400.7 413.34,406.24 413.02,406.56 U5.50 ; 430.24,55.43 430.24,42.35 433.79,38.81 453.49,38.81 456.17,36.13 456.17,31.6 460.3,27.47 460.3,3.71 ; 197.66,432.21 203.37,437.92 223.44,437.92 223.83,438.31 223.83,439.37 217.86,445.34 v2(217.86,476.35) ; 178.44,407.04 178.44,406.54 177.47,405.57 177.47,400.38 175.42,398.33 167.21,398.33 155.57,409.96 155.57,427.6 167.47,439.5 167.47,445.89 166.1,447.27 166.1,476.37 ; 43.53,430.74 47.16,434.36 67.23,434.36 69.71,436.83 69.71,442.13 72.92,445.34 v2(72.92,476.35) ; 152.94,3.72 152.94,27.55 157.99,32.59 157.99,34.73 157.39,35.32 155.07,35.32 149.09,41.31 149.09,54.35 ; v2(392,3.72) 392,27.55 395.21,30.76 395.21,35.02 394.2,36.03 391.88,36.03 386.31,41.6 386.31,54.06 ; 121.27,431.2 121.27,402.36 124.59,399.04 135.71,399.04 137.35,400.68 137.35,406.22 137.03,406.54 137.03,407.04 ; v1(136.97,53.21) 136.97,53.72 132.14,58.55 132.14,60.76 128.83,64.07 117.48,64.07 110.61,57.2 ; 349.61,56.17 355.02,61.57 364.31,61.57 366.16,59.73 366.16,54.04 366.48,53.72 366.48,53.21 ; 351.76,55.28 351.76,42.5 355.09,39.16 374.8,39.16 377.69,36.27 377.69,32.52 382.74,27.47 v2(382.74,3.71) ; v2(395.82,3.72) 395.82,27.55 396.28,28 396.28,35.46 394.64,37.1 392.32,37.1 387.38,42.04 387.38,53.62 ; U1.78 257.31,406.51 256.34,405.55 256.34,400.36 254.28,398.3 246.08,398.3 234.44,409.94 234.44,427.57 246.34,439.47 246.34,445.86 244.96,447.24 v2(244.96,476.35) ; 363.48,53.21 363.48,53.72 365.09,55.33 365.09,59.28 363.87,60.51 355.46,60.51 350.68,55.72 ; 271.14,56.02 276.34,61.22 285.34,61.22 286.98,59.58 286.98,54.04 286.66,53.72 U4.80 ; v2(61.45,476.35) 61.45,445.34 66.5,440.29 66.5,438.16 65.91,437.56 45.83,437.56 40.33,432.06 ; U5.84 372.61,406.56 373.58,405.59 373.58,400.84 372.15,399.41 361.32,399.41 358.21,402.53 358.21,431.08 ; 228.3,54.18 238.73,64.62 245.02,64.62 249.35,60.29 249.35,56.59 252.25,53.69 v1(252.25,53.21) 252.25,53.19 ; 118.43,432.38 124.35,438.3 144.43,438.3 144.61,438.48 137.72,445.37 137.72,476.38 ; 176.41,53.21 176.41,53.72 171.58,58.55 171.58,60.76 166.62,65.71 159.45,65.71 148.39,54.65 ; 172.44,407.04 172.44,406.54 175.34,403.64 175.34,401.27 174.53,400.46 168.09,400.46 157.71,410.85 157.71,426.71 169.61,438.61 169.61,443.14 173.74,447.27 173.74,476.37 ; U3.26 55.13,53.72 52.23,56.61 52.23,60.32 49.55,63 39.08,63 32.84,56.76 ; U1.76 258.31,406.51 256.7,404.9 256.7,400.21 254.43,397.94 245.93,397.94 234.08,409.79 234.08,427.72 245.98,439.62 245.98,444.95 243.69,447.24 v2(243.69,476.35) ; 350.33,55.87 355.32,60.86 364.02,60.86 365.45,59.43 365.45,54.68 364.48,53.72 364.48,53.21 ; v2(58.46,3.71) 58.46,27.47 59.84,28.85 59.84,35.24 58.41,36.67 38.7,36.67 33.91,41.46 33.91,56.31 ; 154.28,476.38 154.28,445.37 149.24,440.32 149.24,436.57 146.34,433.67 126.27,433.67 123.06,430.47 ; 351.4,55.43 351.4,42.35 354.94,38.81 374.65,38.81 377.33,36.13 377.33,31.6 381.46,27.47 v2(381.46,3.71) ; 333.09,53.21 333.09,53.72 328.9,57.9 328.9,60.61 324.16,65.36 317.28,65.36 306.43,54.5 ; v2(83.01,3.72) 83.01,27.55 81.64,28.92 81.64,35.76 79.58,37.81 77.26,37.81 72.74,42.34 72.74,53.32 ; 86.56,53.21 86.56,53.72 88.82,55.97 88.82,59.14 86.16,61.8 82.23,61.8 73.46,53.03 ; 153.73,52.44 161.66,60.37 164.41,60.37 166.11,58.67 166.11,58.42 161.41,53.72 161.41,53.21 ; 348.19,56.76 354.43,63 364.9,63 367.58,60.32 367.58,56.61 370.48,53.72 370.48,53.21 ; 337.12,407.02 337.12,406.51 335.51,404.9 335.51,400.21 333.25,397.94 324.74,397.94 312.9,409.79 312.9,427.72 324.8,439.62 324.8,444.95 322.5,447.24 322.5,476.35 ; 347.12,57.2 353.99,64.07 365.35,64.07 368.65,60.76 368.65,58.55 373.48,53.72 373.48,53.21 ; 306.42,54.5 306.42,41.16 312.61,34.97 314.93,34.97 315.32,34.58 315.32,33.51 309.35,27.55 309.35,3.72 ; 112.4,56.46 112.4,41.32 117.4,36.32 137.11,36.32 138.33,35.09 138.33,29.77 136.03,27.47 136.03,3.71 ; 73.45,53.03 73.45,42.63 77.56,38.53 79.88,38.53 82.35,36.05 82.35,30.76 85.56,27.55 v2(85.56,3.72) ; 113.82,55.87 118.81,60.86 127.51,60.86 128.94,59.43 128.94,54.68 127.97,53.72 127.97,53.21 ; 455.21,3.71 455.21,27.47 454.75,27.93 454.75,35.54 452.9,37.38 433.2,37.38 428.82,41.76 428.82,56.02 ; 231.86,52.71 240.21,61.06 243.55,61.06 245.79,58.82 245.79,57.23 242.25,53.69 U4.38 242.25,53.19 ; 33.55,56.46 33.55,41.32 38.56,36.32 58.26,36.32 59.48,35.09 59.48,29.77 57.19,27.47 v2(57.19,3.71) ; 73.1,53.17 82.08,62.15 86.31,62.15 89.17,59.28 89.17,55.33 87.56,53.72 87.56,53.21 ; 277.53,431.77 277.53,401.75 281.69,397.59 293.99,397.59 296.46,400.06 296.46,404.26 298.72,406.51 U1.42 ; 351.39,55.43 355.76,59.79 363.58,59.79 364.38,58.99 364.38,56.61 361.48,53.72 v1(361.48,53.21) ; 182.44,407.04 182.44,406.54 178.9,403 178.9,399.79 176.01,396.9 166.62,396.9 154.15,409.37 154.15,428.19 166.05,440.09 166.05,442.22 161,447.27 161,476.37 ; v2(231.88,476.35) 231.88,445.34 227.75,441.21 227.75,436.69 225.06,434 204.99,434 201.57,430.59 ; 43.88,430.59 43.88,402.93 46.37,400.44 56.31,400.44 57.11,401.24 57.11,403.62 54.22,406.51 v1(54.22,407.02) ; U5.54 411.02,406.56 412.63,404.95 412.63,400.99 411.41,399.77 404.38,399.77 393.58,410.57 393.58,427.03 405.48,438.93 405.48,444.99 407.77,447.29 407.77,476.39 ; U1.46 296.72,406.51 295.75,405.55 295.75,400.36 293.69,398.3 281.98,398.3 278.24,402.04 278.24,431.47 ; 190.52,56.73 196.76,62.97 207.23,62.97 209.91,60.29 209.91,56.59 212.81,53.69 212.81,53.19 ; 438.83,430.33 438.83,403.26 440.9,401.19 450.25,401.19 450.64,401.58 450.64,402.37 446.45,406.56 446.45,407.06 ; 309.99,53.03 318.76,61.8 322.69,61.8 325.35,59.14 325.35,55.97 323.09,53.72 323.09,53.21 ; 229.71,53.59 229.71,42.02 234.65,37.08 236.97,37.08 238.61,35.44 238.61,27.98 238.15,27.52 238.15,3.69 ; 31.77,57.2 31.77,40.58 37.82,34.54 57.52,34.54 57.58,34.48 57.58,34.23 50.82,27.47 v2(50.82,3.71) ; v1(211.9,407.02) 211.9,406.51 214.8,403.62 214.8,401.24 213.99,400.44 204.05,400.44 201.56,402.93 201.56,430.59 ; 279.32,431.03 283.36,435.07 303.44,435.07 305.49,437.13 305.49,443.96 306.87,445.34 306.87,476.35 ; 435.28,431.81 440.36,436.89 460.44,436.89 461.45,437.91 461.45,442.17 458.24,445.38 458.24,476.39 ; 130.03,407.04 v1(130.03,407.02) 130.03,406.54 134.86,401.71 134.68,401.53 125.63,401.53 123.76,403.39 123.76,430.17 ; v1(411.92,53.21) 411.92,53.72 407.73,57.9 407.73,60.61 402.99,65.36 396.11,65.36 385.25,54.5 ; 301.78,476.35 301.78,445.34 304.07,443.05 304.07,437.72 302.85,436.5 282.77,436.5 277.9,431.62 ; 142.03,407.04 142.03,406.54 139.13,403.64 139.13,399.94 136.45,397.26 123.86,397.26 119.49,401.62 119.49,431.94 ; 123.77,430.17 126.57,432.96 146.64,432.96 149.95,436.27 149.95,438.48 156.83,445.37 156.83,476.38 ; 316.99,3.72 316.99,27.55 317.45,28 317.45,35.46 315.81,37.1 313.49,37.1 308.55,42.04 308.55,53.62 ; 72.38,53.47 72.38,42.19 77.11,37.46 79.43,37.46 81.28,35.61 81.28,28 81.74,27.55 v2(81.74,3.72) ; U3.32 58.13,53.72 53.3,58.55 53.3,60.76 49.99,64.07 38.63,64.07 31.77,57.2 ; U4.74 283.66,53.72 285.91,55.97 285.91,59.14 284.9,60.15 276.78,60.15 272.21,55.58 ; 325.05,476.35 325.05,447.24 325.51,446.78 325.51,439.32 313.61,427.42 313.61,410.08 325.04,398.66 332.95,398.66 334.8,400.5 334.8,406.19 335.12,406.51 335.12,407.02 ; 431.31,54.99 435.04,58.73 441.98,58.73 442.16,58.55 437.33,53.72 U6.66 ; U3.28 56.13,53.72 52.59,57.26 52.59,60.46 49.7,63.35 38.93,63.35 32.48,56.9 ; 278.97,431.18 283.22,435.43 303.29,435.43 305.14,437.28 305.14,444.88 305.6,445.34 305.6,476.35 ; 177.56,476.37 177.56,447.27 170.68,440.38 170.68,438.17 158.78,426.27 158.78,411.29 168.54,401.53 174.09,401.53 174.27,401.71 169.44,406.54 169.44,407.04 ; 381.95,476.4 381.95,445.39 383.32,444.01 383.32,437.62 381.89,436.19 361.82,436.19 357.15,431.52 ; 234.33,3.69 234.33,27.52 237.54,30.73 237.54,35 236.53,36.01 234.21,36.01 228.64,41.58 228.64,54.03 ; U5.46 415.02,406.56 414.05,405.59 414.05,400.4 412,398.35 403.79,398.35 392.15,409.98 392.15,427.62 404.05,439.52 404.05,445.91 402.68,447.29 402.68,476.39 ; 199.07,431.62 199.07,401.89 203.02,397.94 215.02,397.94 217.29,400.21 217.29,404.9 218.9,406.51 U1.108 ; 206.81,53.19 206.81,53.69 207.78,54.66 207.78,59.41 206.35,60.84 197.65,60.84 192.65,55.85 ; v1(451.33,53.21) 451.33,53.72 447.14,57.9 447.14,60.61 444.04,63.71 